# EasyEDA Pro project kuafu01_030内部老化方案_4.eprj, board PCB4 (continued)
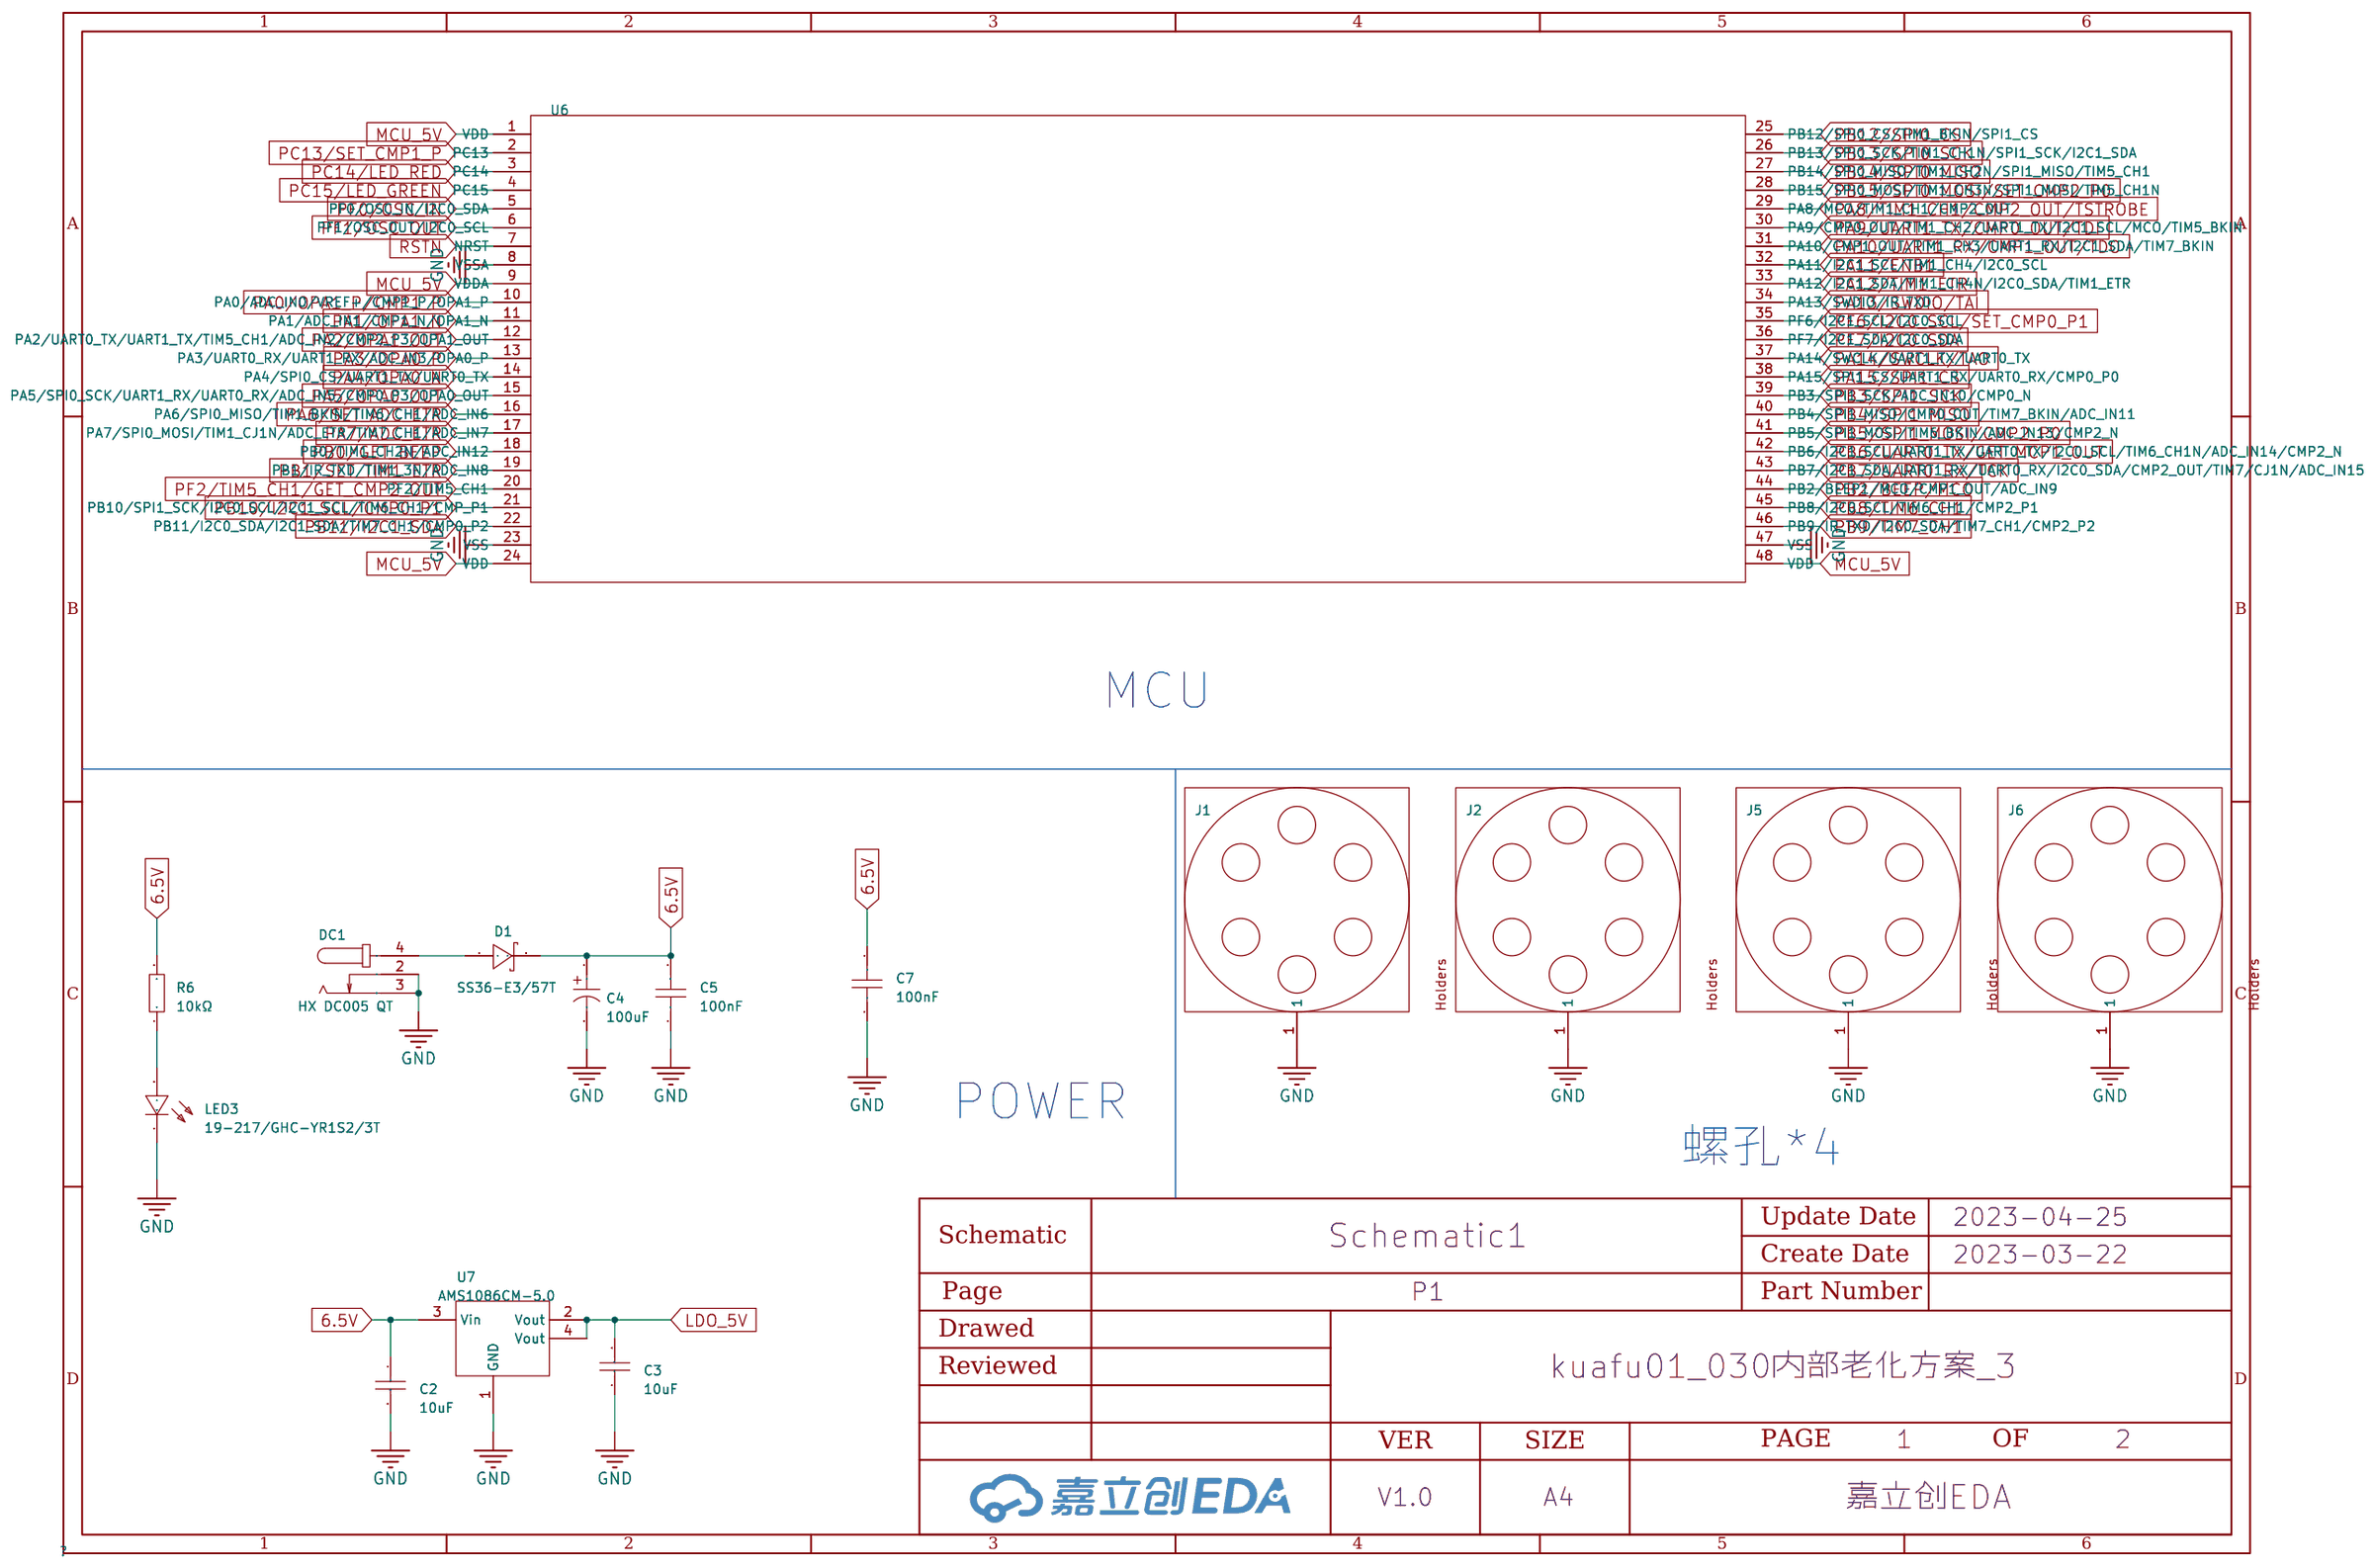
[diagram p0: P1]
## Routing (per net, layer and track width the routed paths; a pad name or vN(x,y) marks a point on that pad's centre or on a via; arc(x,y) is an arc through that point) (continued)
$3N9153: length 9
  Top Layer w0.5: D1.1 80.18,15.89 DC1.4
$3N9301: length 2.3
  Top Layer w0.5: R6.1 94.63,11.23 LED3.2
$4N6329: length 54.7
  Top Layer w0.28: LED2#31.1 59.97,200.62 ; LED2#11.1 110.52,163.03 ; LED2#23.1 9.43,238.21 ; LED2#19.1 59.97,87.85 ; LED2#13.1 9.43,50.25 ; LED2#26.1 161.06,238.21 ; LED2#9.1 161.06,125.44 ; LED2#5.1 211.61,125.44 ; LED2#25.1 211.61,12.66 ; LED2#18.1 211.61,87.85 ; LED2#6.1 59.97,125.44 ; LED2#4.1 9.43,163.03 ; LED2#12.1 110.52,50.25 ; LED2#28.1 9.43,200.62 ; LED2#27.1 211.61,238.21 ; LED2#3.1 59.97,238.21 ; LED2#8.1 59.97,163.03 ; LED2#16.1 211.61,50.25 ; LED2#15.1 9.43,87.85 ; LED2#2.1 9.43,125.44 ; LED2#24.1 9.43,12.66 ; LED2#14.1 110.52,238.21 ; LED2#7.1 211.61,163.03 ; LED2#30.1 110.52,200.62 ; LED2#20.1 161.06,50.25 ; LED2#21.1 161.06,87.85 ; LED2#10.1 161.06,163.03 ; LED2#32.1 161.06,200.62 ; LED2#17.1 59.97,50.25 ; LED2#29.1 211.61,200.62 ; LED2.1 110.52,125.44 ; LED2#22.1 110.52,87.85
$4N6330: length 56.9
  Top Layer w0.28: R1#28.2 9.51,203.48 7.74,203.48 ; LED1#19.1 60.06,53.11 R1#13.2 ; 7.74,53.11 9.51,53.11 R1#15.2 ; LED1#31.1 110.61,203.48 R1#30.2 ; 7.74,90.7 9.51,90.7 R1#14.2 ; LED1#2.1 110.61,128.3 R1#6.2 ; LED1#25.1 211.7,15.52 R1#25.2 ; R1#18.2 60.06,90.7 LED1#14.1 ; LED1#9.1 60.06,128.3 R1#2.2 ; LED1#3.1 60.06,165.89 R1#7.2 ; LED1#27.1 60.06,241.07 R1.2 ; R1#31.2 60.06,203.48 LED1#28.1 ; LED1.1 211.7,165.89 R1#5.2 ; R1#4.2 9.51,128.3 7.74,128.3 ; R1#27.2 211.7,241.07 LED1#26.1 ; R1#29.2 211.7,203.48 LED1#29.1 ; LED1#10.1 161.15,128.3 R1#9.2 ; LED1#17.1 211.7,53.11 R1#19.2 ; R1#8.2 211.7,128.3 LED1#7.1 ; LED1#12.1 211.7,90.7 R1#16.2 ; LED1#18.1 161.15,90.7 R1#22.2 ; 7.74,15.52 9.51,15.52 R1#24.2 ; R1#12.2 110.61,165.89 LED1#11.1 ; R1#11.2 110.61,241.07 LED1#6.1 ; LED1#21.1 161.15,241.07 R1#26.2 ; R1#23.2 110.61,90.7 LED1#22.1 ; LED1#13.1 110.61,53.11 R1#17.2 ; R1#32.2 161.15,203.48 LED1#32.1 ; 7.74,241.07 9.51,241.07 R1#21.2 ; R1#20.2 161.15,53.11 LED1#20.1 ; R1#3.2 9.51,165.89 7.74,165.89 ; LED1#8.1 161.15,165.89 R1#10.2
$4N10186: length 802.6
  Top Layer w0.28: v1(11.7,156.04) 14.36,153.38 22.5,153.38 22.9,153.78 U2#6.3 ; v1(112.8,43.26) 115.46,40.6 123.6,40.6 124,41 U2#12.3 ; v1(11.7,193.63) 14.36,190.97 22.5,190.97 22.9,191.37 U2#30.3 ; v1(112.8,193.63) 115.46,190.97 123.6,190.97 124,191.37 U2#31.3 ; v1(62.25,231.22) 64.91,228.56 73.05,228.56 73.45,228.96 U2#8.3 ; U2#13.3 22.9,41 22.5,40.6 14.36,40.6 v1(11.7,43.26) ; U2#27.3 225.09,228.96 224.69,228.56 216.55,228.56 v1(213.89,231.22) ; U2#7.3 225.09,116.19 224.69,115.79 216.55,115.79 v1(213.89,118.45) ; v1(112.8,80.86) 115.46,78.2 123.6,78.2 124,78.6 U2#22.3 ; v1(163.34,118.45) 166,115.79 174.14,115.79 174.54,116.19 U2#9.3 ; U2#15.3 73.45,78.6 73.05,78.2 64.91,78.2 v1(62.25,80.86) ; v1(163.34,43.26) 166,40.6 174.14,40.6 174.54,41 U2#19.3 ; v1(62.25,193.63) 64.91,190.97 73.05,190.97 73.45,191.37 U2#29.3 ; U2#4.3 73.45,153.78 73.05,153.38 64.91,153.38 v1(62.25,156.04) ; U2#24.3 22.9,3.41 22.5,3.01 14.36,3.01 v1(11.7,5.67) ; U2#20.3 174.54,78.6 174.14,78.2 166,78.2 v1(163.34,80.86) ; v1(62.25,118.45) 64.91,115.79 73.05,115.79 73.45,116.19 U2#3.3 ; v1(213.89,5.67) 216.55,3.01 224.69,3.01 225.09,3.41 U2#25.3 ; v1(163.34,231.22) 166,228.56 174.14,228.56 174.54,228.96 U2#26.3 ; U2#11.3 124,153.78 123.6,153.38 115.46,153.38 v1(112.8,156.04) ; U2#18.3 225.09,41 224.69,40.6 216.55,40.6 v1(213.89,43.26) ; U2.3 124,116.19 123.6,115.79 115.46,115.79 v1(112.8,118.45) ; U2#32.3 174.54,191.37 174.14,190.97 166,190.97 v1(163.34,193.63) ; v1(112.8,231.22) 115.46,228.56 123.6,228.56 124,228.96 U2#21.3 ; U2#10.3 174.54,153.78 174.14,153.38 166,153.38 v1(163.34,156.04) ; U2#14.3 73.45,41 73.05,40.6 64.91,40.6 v1(62.25,43.26) ; U2#2.3 22.9,116.19 22.5,115.79 14.36,115.79 v1(11.7,118.45) ; v1(11.7,231.22) 14.36,228.56 22.5,228.56 22.9,228.96 U2#23.3 ; v1(213.89,156.04) 216.55,153.38 224.69,153.38 225.09,153.78 U2#5.3 ; U2#28.3 225.09,191.37 224.69,190.97 216.55,190.97 v1(213.89,193.63) ; v1(213.89,80.86) 216.55,78.2 224.69,78.2 225.09,78.6 U2#16.3 ; v1(11.7,80.86) 14.36,78.2 22.5,78.2 22.9,78.6 U2#17.3
  Bottom Layer w0.28: v1(163.34,156.04) 163.32,156.06 163.32,164.91 164.27,165.86 H7#11.1 ; v1(11.7,156.04) 11.68,156.06 11.68,164.91 12.63,165.86 H7#9.1 ; v1(213.89,5.67) 213.87,5.69 213.87,14.54 214.82,15.49 H7#24.1 ; H7#3.1 12.63,128.27 11.68,127.32 11.68,118.47 v1(11.7,118.45) ; v1(11.7,193.63) 11.68,193.65 11.68,202.5 12.63,203.45 H7#31.1 ; v1(62.25,156.04) 62.23,156.06 62.23,164.91 63.18,165.86 H7#10.1 ; v1(163.34,193.63) 163.32,193.65 163.32,202.5 164.27,203.45 H7#32.1 ; v1(11.7,80.86) 11.68,80.88 11.68,89.73 12.63,90.68 H7#20.1 ; H7#2.1 214.82,128.27 213.87,127.32 213.87,118.47 v1(213.89,118.45) ; H7#29.1 63.18,203.45 62.23,202.5 62.23,193.65 v1(62.25,193.63) ; H7#7.1 214.82,165.86 213.87,164.91 213.87,156.06 v1(213.89,156.04) ; v1(163.34,80.86) 163.32,80.88 163.32,89.73 164.27,90.68 H7#22.1 ; v1(213.89,43.26) 213.87,43.29 213.87,52.14 214.82,53.09 H7#12.1 ; H7#28.1 113.72,203.45 112.77,202.5 112.77,193.65 v1(112.8,193.63) ; H7#14.1 113.72,241.05 112.77,240.1 112.77,231.25 v1(112.8,231.22) ; H7#23.1 12.63,15.49 11.68,14.54 11.68,5.69 v1(11.7,5.67) ; v1(213.89,193.63) 213.87,193.65 213.87,202.5 214.82,203.45 H7#30.1 ; v1(62.25,118.45) 62.23,118.47 62.23,127.32 63.18,128.27 H7#8.1 ; H7#27.1 214.82,241.05 213.87,240.1 213.87,231.25 v1(213.89,231.22) ; v1(11.7,43.26) 11.68,43.29 11.68,52.14 12.63,53.09 H7#13.1 ; v1(62.25,43.26) 62.23,43.29 62.23,52.14 63.18,53.09 H7#19.1 ; v1(112.8,43.26) 112.77,43.29 112.77,52.14 113.72,53.09 H7#15.1 ; H7#5.1 113.72,165.86 112.77,164.91 112.77,156.06 v1(112.8,156.04) ; v1(112.8,118.45) 112.77,118.47 112.77,127.32 113.72,128.27 H7#4.1 ; v1(163.34,43.26) 163.32,43.29 163.32,52.14 164.27,53.09 H7#17.1 ; v1(163.34,118.45) 163.32,118.47 163.32,127.32 164.27,128.27 H7#6.1 ; v1(112.8,80.86) 112.77,80.88 112.77,89.73 113.72,90.68 H7#16.1 ; H7#25.1 12.63,241.05 11.68,240.1 11.68,231.25 v1(11.7,231.22) ; v1(213.89,80.86) 213.87,80.88 213.87,89.73 214.82,90.68 H7#18.1 ; H7.1 63.18,241.05 62.23,240.1 62.23,231.25 v1(62.25,231.22) ; H7#21.1 63.18,90.68 62.23,89.73 62.23,80.88 v1(62.25,80.86) ; H7#26.1 164.27,241.05 163.32,240.1 163.32,231.25 v1(163.34,231.22)
$4N10193: length 1300.8
  Top Layer w0.28: v1(251.87,2.5) 251.86,2.51 233.82,2.51 231.62,4.71 U2#25.6 ; U2#32.6 181.07,192.67 183.27,190.47 201.31,190.47 v1(201.32,190.46) ; v1(150.78,115.28) 150.77,115.29 132.73,115.29 130.53,117.49 U2.6 ; U2#9.6 181.07,117.49 183.27,115.29 201.31,115.29 v1(201.32,115.28) ; v1(49.68,2.5) 49.67,2.51 31.63,2.51 29.43,4.71 U2#24.6 ; v1(100.23,228.05) 100.22,228.06 82.18,228.06 79.98,230.26 U2#8.6 ; U2#29.6 79.98,192.67 82.18,190.47 100.22,190.47 v1(100.23,190.46) ; U2#20.6 181.07,79.9 183.27,77.7 201.31,77.7 v1(201.32,77.69) ; U2#28.6 231.62,192.67 233.82,190.47 251.86,190.47 v1(251.87,190.46) ; v1(150.78,152.87) 150.77,152.88 132.73,152.88 130.53,155.08 U2#11.6 ; U2#26.6 181.07,230.26 183.27,228.06 201.31,228.06 v1(201.32,228.05) ; v1(100.23,115.28) 100.22,115.29 82.18,115.29 79.98,117.49 U2#3.6 ; v1(150.78,190.46) 150.77,190.47 132.73,190.47 130.53,192.67 U2#31.6 ; v1(49.68,152.87) 49.67,152.88 31.63,152.88 29.43,155.08 U2#6.6 ; U2#22.6 130.53,79.9 132.73,77.7 150.77,77.7 v1(150.78,77.69) ; U2#17.6 29.43,79.9 31.63,77.7 49.67,77.7 v1(49.68,77.69) ; U2#10.6 181.07,155.08 183.27,152.88 201.31,152.88 v1(201.32,152.87) ; U2#2.6 29.43,117.49 31.63,115.29 49.67,115.29 v1(49.68,115.28) ; v1(251.87,115.28) 251.86,115.29 233.82,115.29 231.62,117.49 U2#7.6 ; v1(100.23,152.87) 100.22,152.88 82.18,152.88 79.98,155.08 U2#4.6 ; U2#23.6 29.43,230.26 31.63,228.06 49.67,228.06 v1(49.68,228.05) ; U2#15.6 79.98,79.9 82.18,77.7 100.22,77.7 v1(100.23,77.69) ; U2#19.6 181.07,42.3 183.27,40.1 201.31,40.1 v1(201.32,40.09) ; U2#27.6 231.62,230.26 233.82,228.06 251.86,228.06 v1(251.87,228.05) ; U2#5.6 231.62,155.08 233.82,152.88 251.86,152.88 v1(251.87,152.87) ; U2#16.6 231.62,79.9 233.82,77.7 251.86,77.7 v1(251.87,77.69) ; U2#18.6 231.62,42.3 233.82,40.1 251.86,40.1 v1(251.87,40.09) ; v1(150.78,40.09) 150.77,40.1 132.73,40.1 130.53,42.3 U2#12.6 ; U2#13.6 29.43,42.3 31.63,40.1 49.67,40.1 v1(49.68,40.09) ; v1(100.23,40.09) 100.22,40.1 82.18,40.1 79.98,42.3 U2#14.6 ; v1(49.68,190.46) 49.67,190.47 31.63,190.47 29.43,192.67 U2#30.6 ; v1(150.78,228.05) 150.77,228.06 132.73,228.06 130.53,230.26 U2#21.6
  Bottom Layer w0.28: v1(49.68,77.69) 49.69,77.7 49.69,89.98 49,90.68 H6#14.1 ; H6#3.1 49,165.86 49.69,165.16 49.69,152.88 v1(49.68,152.87) ; H6#8.1 200.63,128.27 201.33,127.57 201.33,115.29 v1(201.32,115.28) ; v1(100.23,152.87) 100.24,152.88 100.24,165.16 99.54,165.86 H6#11.1 ; v1(201.32,190.46) 201.33,190.47 201.33,202.76 200.63,203.45 H6#31.1 ; H6#26.1 200.63,241.05 201.33,240.35 201.33,228.06 v1(201.32,228.05) ; H6#20.1 150.09,90.68 150.79,89.98 150.79,77.7 v1(150.78,77.69) ; H6.1 99.54,241.05 100.24,240.35 100.24,228.06 v1(100.23,228.05) ; H6#7.1 251.18,128.27 251.88,127.57 251.88,115.29 v1(251.87,115.28) ; v1(49.68,190.46) 49.69,190.47 49.69,202.76 49,203.45 H6#29.1 ; H6#21.1 200.63,90.68 201.33,89.98 201.33,77.7 v1(201.32,77.69) ; H6#22.1 99.54,90.68 100.24,89.98 100.24,77.7 v1(100.23,77.69) ; v1(150.78,40.09) 150.79,40.1 150.79,52.39 150.09,53.09 H6#17.1 ; H6#10.1 200.63,165.86 201.33,165.16 201.33,152.88 v1(201.32,152.87) ; v1(100.23,190.46) 100.24,190.47 100.24,202.76 99.54,203.45 H6#32.1 ; v1(201.32,40.09) 201.33,40.1 201.33,52.39 200.63,53.09 H6#19.1 ; H6#9.1 150.09,165.86 150.79,165.16 150.79,152.88 v1(150.78,152.87) ; H6#6.1 150.09,128.27 150.79,127.57 150.79,115.29 v1(150.78,115.28) ; H6#23.1 49,15.49 49.69,14.8 49.69,2.51 v1(49.68,2.5) ; v1(49.68,228.05) 49.69,228.06 49.69,240.35 49,241.05 H6#25.1 ; v1(251.87,228.05) 251.88,228.06 251.88,240.35 251.18,241.05 H6#27.1 ; v1(251.87,190.46) 251.88,190.47 251.88,202.76 251.18,203.45 H6#28.1 ; v1(251.87,77.69) 251.88,77.7 251.88,89.98 251.18,90.68 H6#16.1 ; H6#18.1 251.18,53.09 251.88,52.39 251.88,40.1 v1(251.87,40.09) ; v1(150.78,228.05) 150.79,228.06 150.79,240.35 150.09,241.05 H6#12.1 ; H6#2.1 99.54,128.27 100.24,127.57 100.24,115.29 v1(100.23,115.28) ; H6#13.1 99.54,53.09 100.24,52.39 100.24,40.1 v1(100.23,40.09) ; v1(49.68,40.09) 49.69,40.1 49.69,52.39 49,53.09 H6#15.1 ; H6#5.1 251.18,165.86 251.88,165.16 251.88,152.88 v1(251.87,152.87) ; H6#4.1 49,128.27 49.69,127.57 49.69,115.29 v1(49.68,115.28) ; v1(251.87,2.5) 251.88,2.51 251.88,14.8 251.18,15.49 H6#24.1 ; v1(150.78,190.46) 150.79,190.47 150.79,202.76 150.09,203.45 H6#30.1
$4N10258: length 155.1
  Top Layer w0.28: R2#10.1 62.76,163.03 65.28,160.5 ; R2#6.1 12.21,125.44 14.74,122.91 ; 166.37,122.91 163.85,125.44 R2#8.1 ; R2#17.1 12.21,50.25 14.74,47.73 ; 14.74,235.69 12.21,238.22 10.93,238.22 ; 166.37,198.1 163.85,200.62 R2#32.1 ; 115.83,47.73 113.3,50.25 R2#12.1 ; 115.83,160.5 113.3,163.03 R2#11.1 ; R2#25.1 214.39,12.66 216.92,10.14 ; 162.57,238.22 163.85,238.22 166.37,235.69 ; R2#30.1 12.21,200.62 14.74,198.1 ; 213.12,238.22 214.39,238.22 216.92,235.69 ; R2#5.1 12.21,163.03 14.74,160.5 ; 65.28,235.69 62.76,238.22 61.48,238.22 ; R2#4.1 62.76,125.44 65.28,122.91 ; 216.92,160.5 214.39,163.03 R2#3.1 ; 166.37,47.73 163.85,50.25 R2#19.1 ; R2#24.1 12.21,12.66 14.74,10.14 ; R2#2.1 113.3,125.44 115.83,122.91 ; 166.37,85.32 163.85,87.85 R2#20.1 ; 14.74,85.32 12.21,87.85 R2#16.1 ; R2#9.1 163.85,163.03 166.37,160.5 ; 216.92,122.91 214.39,125.44 R2#7.1 ; 216.92,198.1 214.39,200.62 R2#28.1 ; R2#15.1 62.76,50.25 65.28,47.73 ; 216.92,85.32 214.39,87.85 R2#13.1 ; 65.28,85.32 62.76,87.85 R2#22.1 ; R2#23.1 113.3,87.85 115.83,85.32 ; 112.03,238.22 113.3,238.22 115.83,235.69 ; 216.92,47.73 214.39,50.25 R2#18.1 ; R2#31.1 62.76,200.62 65.28,198.1 ; R2#29.1 113.3,200.62 115.83,198.1
$4N10262: length 152.6
  Top Layer w0.28: H1#27.1 214.35,241.07 R1#27.1 ; H1#7.1 113.26,165.88 R1#12.1 ; R1#22.1 163.81,90.7 H1#22.1 ; R1#29.1 214.35,203.48 H1#30.1 ; H1#3.1 62.72,128.29 R1#2.1 ; H1#2.1 214.35,128.29 R1#8.1 ; H1#6.1 214.35,165.88 R1#5.1 ; R1#21.1 12.17,241.07 H1#24.1 ; R1#4.1 12.17,128.29 H1#4.1 ; R1#17.1 113.26,53.11 H1#16.1 ; H1#26.1 163.81,241.07 R1#26.1 ; R1#15.1 12.17,53.11 H1#14.1 ; H1#5.1 113.26,128.29 R1#6.1 ; H1#25.1 214.35,15.52 R1#25.1 ; H1#9.1 62.72,165.88 R1#7.1 ; H1#20.1 62.72,90.7 R1#18.1 ; R1#11.1 113.26,241.07 H1#15.1 ; H1.1 62.72,241.07 R1.1 ; H1#10.1 163.81,128.29 R1#9.1 ; R1#3.1 12.17,165.88 H1#8.1 ; H1#29.1 113.26,203.48 R1#30.1 ; H1#21.1 163.81,53.11 R1#20.1 ; R1#28.1 12.17,203.48 H1#31.1 ; H1#17.1 214.35,90.7 R1#16.1 ; H1#28.1 62.72,203.48 R1#31.1 ; H1#19.1 12.17,90.7 R1#14.1 ; H1#13.1 62.72,53.11 R1#13.1 ; H1#11.1 163.81,165.88 R1#10.1 ; R1#24.1 12.17,15.52 H1#23.1 ; R1#23.1 113.26,90.7 H1#18.1 ; R1#32.1 163.81,203.48 H1#32.1 ; H1#12.1 214.35,53.11 R1#19.1
$4N16114: length 637.8
  Top Layer w0.28: U2#21.4 125.72,228.09 114.03,228.09 113.6,228.52 v1(113.6,228.97) ; U2#23.4 24.62,228.09 12.93,228.09 12.5,228.52 v1(12.5,228.97) ; U2#26.4 176.26,228.09 164.57,228.09 164.14,228.52 v1(164.14,228.97) ; v1(164.14,153.79) 164.14,153.34 164.57,152.91 176.26,152.91 U2#10.4 ; U2#12.4 125.72,40.13 114.03,40.13 113.6,40.56 v1(113.6,41.01) ; v1(113.6,191.38) 113.6,190.93 114.03,190.5 125.72,190.5 U2#31.4 ; v1(113.6,116.2) 113.6,115.75 114.03,115.32 125.72,115.32 U2.4 ; v1(164.14,191.38) 164.14,190.93 164.57,190.5 176.26,190.5 U2#32.4 ; U2#2.4 24.62,115.32 12.93,115.32 12.5,115.75 v1(12.5,116.2) ; v1(63.05,116.2) 63.05,115.75 63.48,115.32 75.17,115.32 U2#3.4 ; v1(214.69,153.79) 214.69,153.34 215.12,152.91 226.81,152.91 U2#5.4 ; U2#25.4 226.81,2.54 215.12,2.54 214.69,2.97 v1(214.69,3.42) ; U2#16.4 226.81,77.73 215.12,77.73 214.69,78.16 v1(214.69,78.61) ; U2#28.4 226.81,190.5 215.12,190.5 214.69,190.93 v1(214.69,191.38) ; U2#27.4 226.81,228.09 215.12,228.09 214.69,228.52 v1(214.69,228.97) ; U2#30.4 24.62,190.5 12.93,190.5 12.5,190.93 v1(12.5,191.38) ; v1(12.5,41.01) 12.5,40.56 12.93,40.13 24.62,40.13 U2#13.4 ; U2#17.4 24.62,77.73 12.93,77.73 12.5,78.16 v1(12.5,78.61) ; v1(63.05,191.38) 63.05,190.93 63.48,190.5 75.17,190.5 U2#29.4 ; v1(12.5,3.42) 12.5,2.97 12.93,2.54 24.62,2.54 U2#24.4 ; v1(164.14,41.01) 164.14,40.56 164.57,40.13 176.26,40.13 U2#19.4 ; U2#15.4 75.17,77.73 63.48,77.73 63.05,78.16 v1(63.05,78.61) ; U2#6.4 24.62,152.91 12.93,152.91 12.5,153.34 v1(12.5,153.79) ; U2#11.4 125.72,152.91 114.03,152.91 113.6,153.34 v1(113.6,153.79) ; U2#9.4 176.26,115.32 164.57,115.32 164.14,115.75 v1(164.14,116.2) ; U2#7.4 226.81,115.32 215.12,115.32 214.69,115.75 v1(214.69,116.2) ; U2#14.4 75.17,40.13 63.48,40.13 63.05,40.56 v1(63.05,41.01) ; U2#18.4 226.81,40.13 215.12,40.13 214.69,40.56 v1(214.69,41.01) ; v1(164.14,78.61) 164.14,78.16 164.57,77.73 176.26,77.73 U2#20.4 ; U2#8.4 75.17,228.09 63.48,228.09 63.05,228.52 v1(63.05,228.97) ; U2#4.4 75.17,152.91 63.48,152.91 63.05,153.34 v1(63.05,153.79) ; v1(113.6,78.61) 113.6,78.16 114.03,77.73 125.72,77.73 U2#22.4
  Bottom Layer w0.28: v1(12.5,116.2) 12.5,119.59 13.31,120.4 14.73,120.4 ; v1(12.5,3.42) 12.5,6.81 13.31,7.62 14.73,7.62 ; v1(214.69,3.42) 214.69,6.81 215.5,7.62 216.92,7.62 ; 65.28,195.58 63.86,195.58 63.05,194.77 v1(63.05,191.38) ; v1(12.5,228.97) 12.5,232.36 13.31,233.17 14.73,233.17 ; 14.73,45.21 13.31,45.21 12.5,44.4 v1(12.5,41.01) ; 166.37,120.4 164.95,120.4 164.14,119.59 v1(164.14,116.2) ; v1(164.14,153.79) 164.14,157.18 164.95,157.99 166.37,157.99 ; v1(113.6,78.61) 113.6,82 114.4,82.8 115.82,82.8 ; 216.92,157.99 215.5,157.99 214.69,157.18 v1(214.69,153.79) ; v1(164.14,191.38) 164.14,194.77 164.95,195.58 166.37,195.58 ; 115.82,120.4 114.4,120.4 113.6,119.59 v1(113.6,116.2) ; 115.82,157.99 114.4,157.99 113.6,157.18 v1(113.6,153.79) ; v1(63.05,116.2) 63.05,119.59 63.86,120.4 65.28,120.4 ; v1(113.6,191.38) 113.6,194.77 114.4,195.58 115.82,195.58 ; 115.82,45.21 114.4,45.21 113.6,44.4 v1(113.6,41.01) ; 216.92,195.58 215.5,195.58 214.69,194.77 v1(214.69,191.38) ; 65.28,82.8 63.86,82.8 63.05,82 v1(63.05,78.61) ; v1(12.5,191.38) 12.5,194.77 13.31,195.58 14.73,195.58 ; v1(214.69,228.97) 214.69,232.36 215.5,233.17 216.92,233.17 ; 166.37,82.8 164.95,82.8 164.14,82 v1(164.14,78.61) ; v1(63.05,153.79) 63.05,157.18 63.86,157.99 65.28,157.99 ; v1(12.5,78.61) 12.5,82 13.31,82.8 14.73,82.8 ; v1(63.05,228.97) 63.05,232.36 63.86,233.17 65.28,233.17 ; v1(113.6,228.97) 113.6,232.36 114.4,233.17 115.82,233.17 ; 14.73,157.99 13.31,157.99 12.5,157.18 v1(12.5,153.79) ; v1(214.69,78.61) 214.69,82 215.5,82.8 216.92,82.8 ; v1(214.69,116.2) 214.69,119.59 215.5,120.4 216.92,120.4 ; v1(164.14,228.97) 164.14,232.36 164.95,233.17 166.37,233.17 ; 216.92,45.21 215.5,45.21 214.69,44.4 v1(214.69,41.01) ; 65.28,45.21 63.86,45.21 63.05,44.4 v1(63.05,41.01) ; 166.37,45.21 164.95,45.21 164.14,44.4 v1(164.14,41.01)
$4N17047: length 136.4
  Top Layer w0.28: 152.08,243.56 147.81,243.56 ; 253.17,205.97 248.91,205.97 ; 152.08,55.6 147.81,55.6 ; 253.17,55.6 248.91,55.6 ; 101.53,205.97 97.27,205.97 ; 152.08,168.38 147.81,168.38 ; 101.53,55.6 97.27,55.6 ; 202.62,55.6 198.36,55.6 ; 253.17,18.01 248.91,18.01 ; 101.53,130.79 97.27,130.79 ; 202.62,168.38 198.36,168.38 ; 50.99,205.97 46.72,205.97 ; 202.62,205.97 198.36,205.97 ; 50.99,168.38 46.72,168.38 ; 50.99,243.56 46.72,243.56 ; 253.17,243.56 248.91,243.56 ; 101.53,93.2 97.27,93.2 ; 152.08,205.97 147.81,205.97 ; 253.17,130.79 248.91,130.79 ; 50.99,93.2 46.72,93.2 ; 101.53,168.38 97.27,168.38 ; 152.08,130.79 147.81,130.79 ; 202.62,130.79 198.36,130.79 ; 253.17,93.2 248.91,93.2 ; 152.08,93.2 147.81,93.2 ; 50.99,55.6 46.72,55.6 ; 253.17,168.38 248.91,168.38 ; 50.99,18.01 46.72,18.01 ; 101.53,243.56 97.27,243.56 ; 50.99,130.79 46.72,130.79 ; 202.62,93.2 198.36,93.2 ; 202.62,243.56 198.36,243.56
$4N17074: length 136.3
  Top Layer w0.28: 46.72,245.99 50.96,245.99 R5#23.1 ; 198.36,133.21 202.6,133.21 R5#8.1 ; 97.27,58.03 101.51,58.03 R5#18.1 ; 97.27,245.99 101.51,245.99 R5.1 ; 97.27,133.21 101.51,133.21 R5#7.1 ; 46.72,208.4 50.96,208.4 R5#29.1 ; 198.36,208.4 202.6,208.4 R5#32.1 ; 46.72,20.44 50.96,20.44 R5#24.1 ; 46.72,170.81 50.96,170.81 R5#3.1 ; R5#17.1 50.96,58.03 46.72,58.03 ; 147.81,133.21 152.06,133.21 R5#2.1 ; 147.81,208.4 152.06,208.4 R5#30.1 ; R5#10.1 101.51,170.81 97.27,170.81 ; 198.36,58.03 202.6,58.03 R5#19.1 ; 198.36,95.62 202.6,95.62 R5#22.1 ; R5#11.1 202.6,170.81 198.36,170.81 ; R5#4.1 253.15,133.21 248.91,133.21 ; R5#25.1 253.15,20.44 248.91,20.44 ; 147.81,245.99 152.06,245.99 R5#12.1 ; 248.91,95.62 253.15,95.62 R5#16.1 ; R5#13.1 152.06,58.03 147.81,58.03 ; R5#26.1 202.6,245.99 198.36,245.99 ; R5#14.1 50.96,95.62 46.72,95.62 ; R5#6.1 50.96,133.21 46.72,133.21 ; 147.81,170.81 152.06,170.81 R5#9.1 ; R5#20.1 152.06,95.62 147.81,95.62 ; R5#15.1 253.15,58.03 248.91,58.03 ; R5#31.1 101.51,208.4 97.27,208.4 ; 248.91,170.81 253.15,170.81 R5#5.1 ; R5#28.1 253.15,208.4 248.91,208.4 ; 97.27,95.62 101.51,95.62 R5#21.1 ; 248.91,245.99 253.15,245.99 R5#27.1
$4N17158: length 136.1
  Top Layer w0.28: H13#24.2 248.93,5.32 R3#24.1 ; R3#32.1 147.84,193.28 H13#32.2 ; H13#20.2 248.93,42.92 R3#19.1 ; H13#3.2 46.75,118.1 R3#3.1 ; R3#23.1 46.75,5.32 H13#23.2 ; R3#10.1 248.93,155.69 H13#7.2 ; R3#7.1 97.29,118.1 H13#4.2 ; R3#5.1 147.84,118.1 H13#5.2 ; H13#29.2 248.93,193.28 R3#28.1 ; H13#25.2 198.38,230.88 R3#26.1 ; R3#11.1 147.84,155.69 H13#10.2 ; R3#2.1 97.29,230.88 H13.2 ; R3#16.1 198.38,42.92 H13#17.2 ; H13#31.2 97.29,193.28 R3#31.1 ; R3#18.1 97.29,80.51 H13#19.2 ; H13#15.2 97.29,42.92 R3#17.1 ; R3.1 46.75,80.51 H13#13.2 ; R3#25.1 46.75,230.88 H13#26.2 ; R3#6.1 198.38,118.1 H13#6.2 ; R3#20.1 248.93,80.51 H13#18.2 ; R3#12.1 147.84,230.88 H13#11.2 ; H13#14.2 46.75,42.92 R3#14.1 ; H13#12.2 198.38,155.69 R3#13.1 ; H13#21.2 147.84,80.51 R3#21.1 ; H13#27.2 248.93,230.88 R3#27.1 ; R3#9.1 248.93,118.1 H13#9.2 ; H13#30.2 198.38,193.28 R3#30.1 ; R3#4.1 46.75,155.69 H13#2.2 ; H13#16.2 147.84,42.92 R3#15.1 ; H13#8.2 97.29,155.69 R3#8.1 ; H13#22.2 198.38,80.51 R3#22.1 ; H13#28.2 46.75,193.28 R3#29.1

## Copper pours and planes (outline as drawn; the poured copper is in the pictures)
GND on Top Layer: 0,265 260,265 260,0 0,0
GND on Bottom Layer: 0,265 260,265 260,0 0,0

## Text on the board
Top Silkscreen Layer: kuafu01_030_HTOL | 澎湃微电子
